# EAGLE board Backplane (EAGLE 7.2.0), part 1 of 2
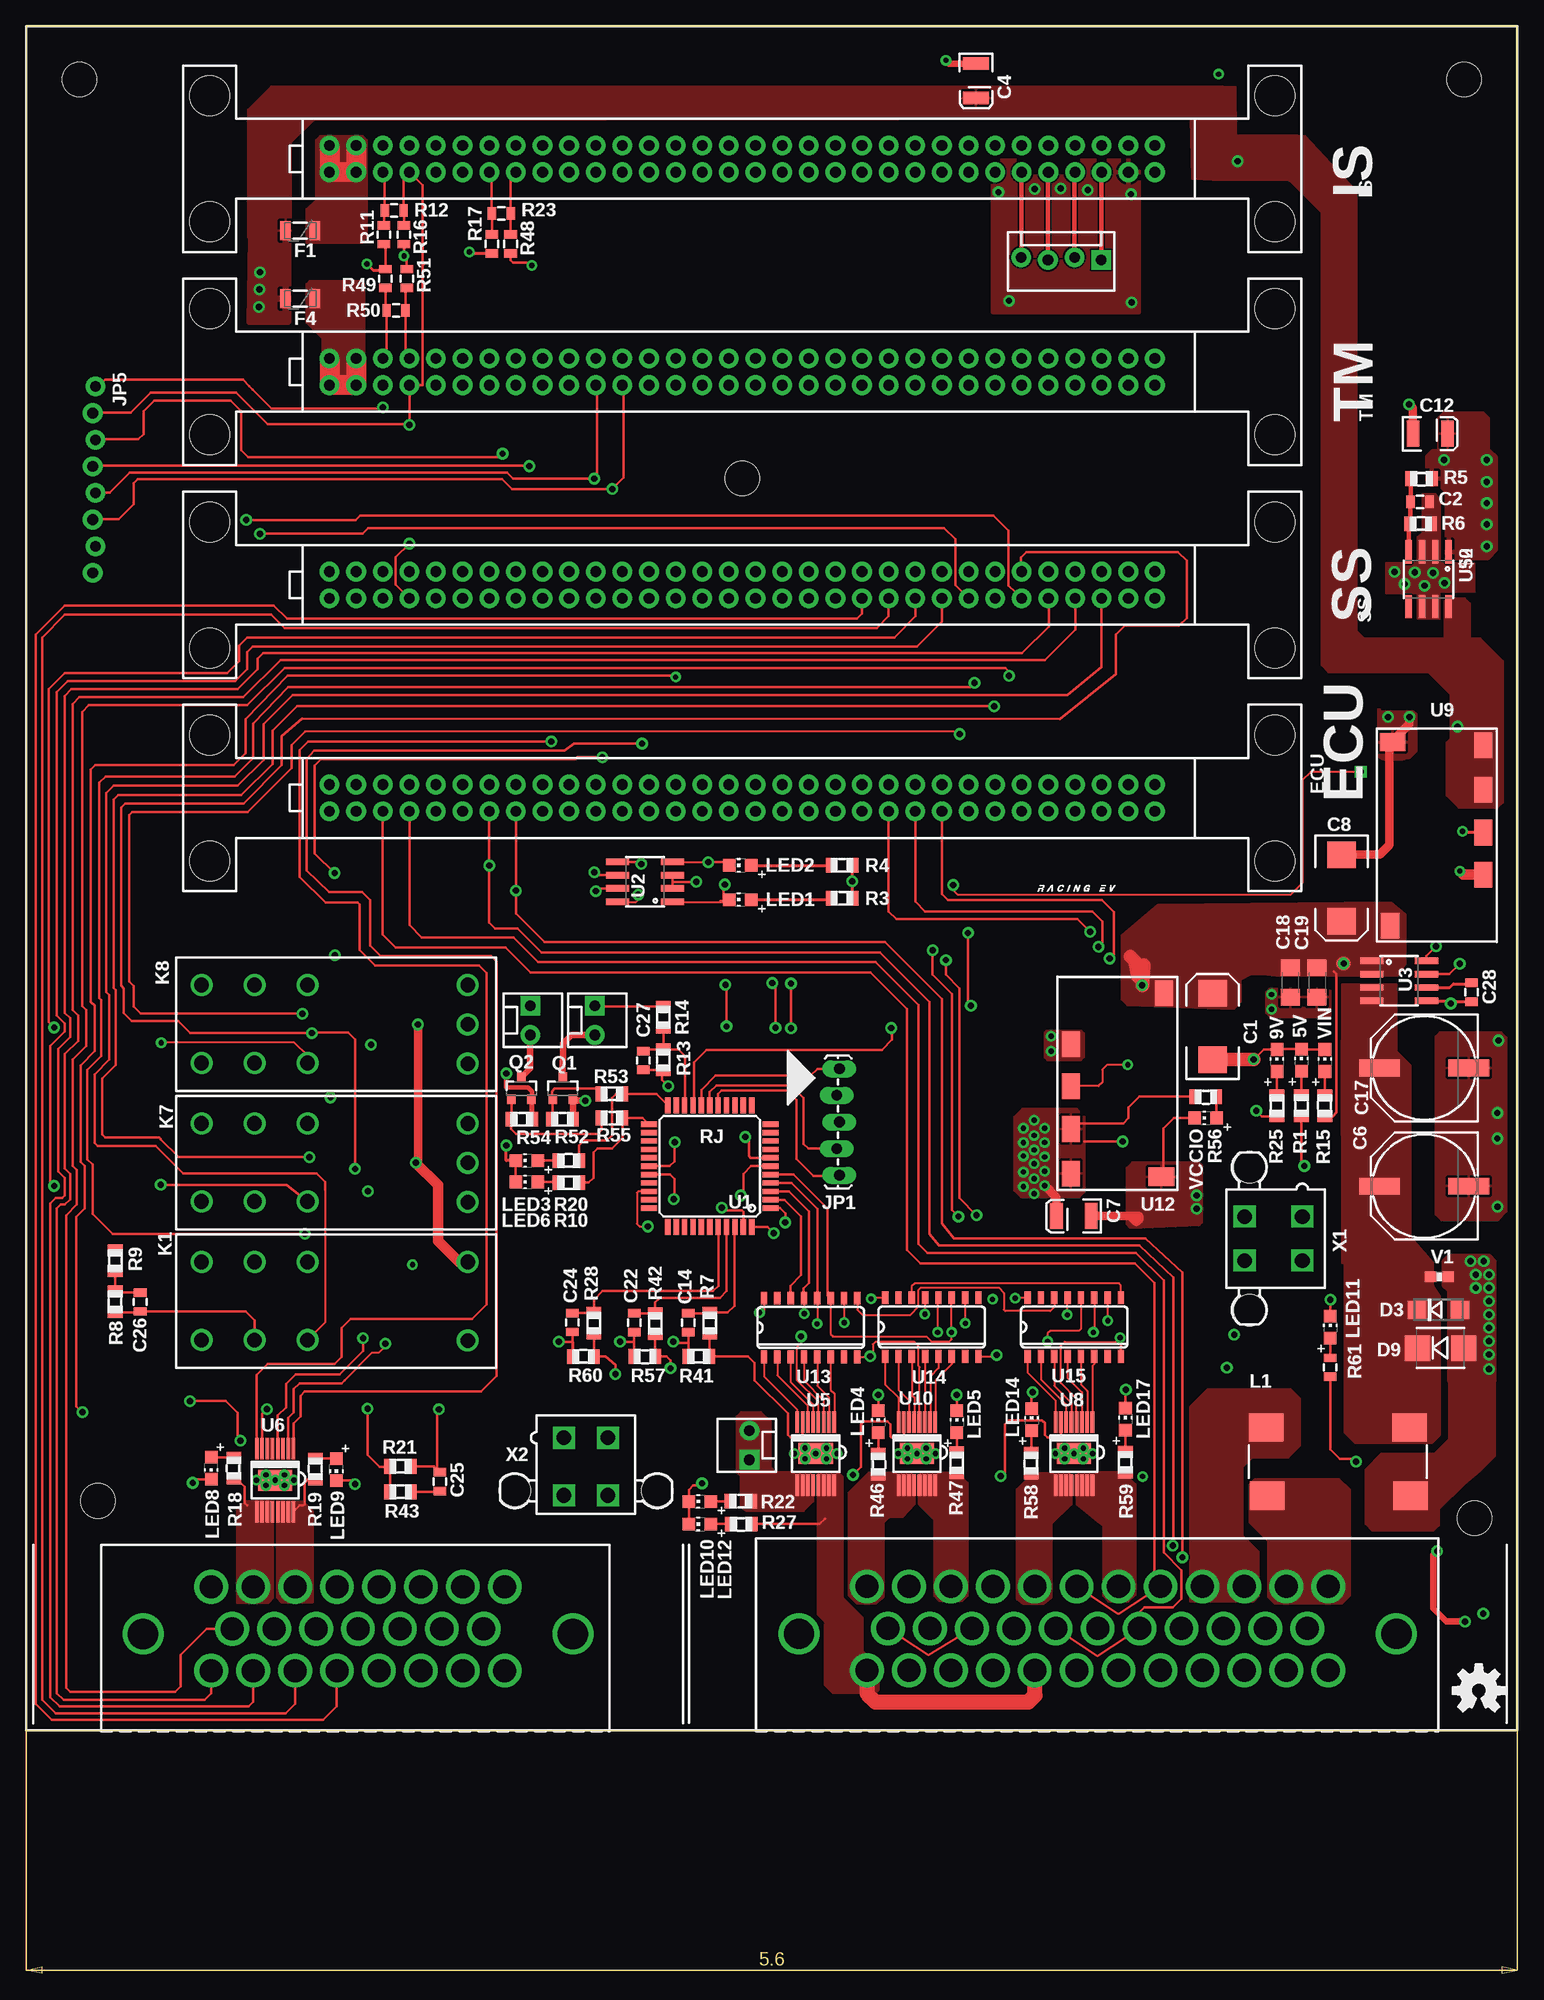
[diagram p5: board, top side]
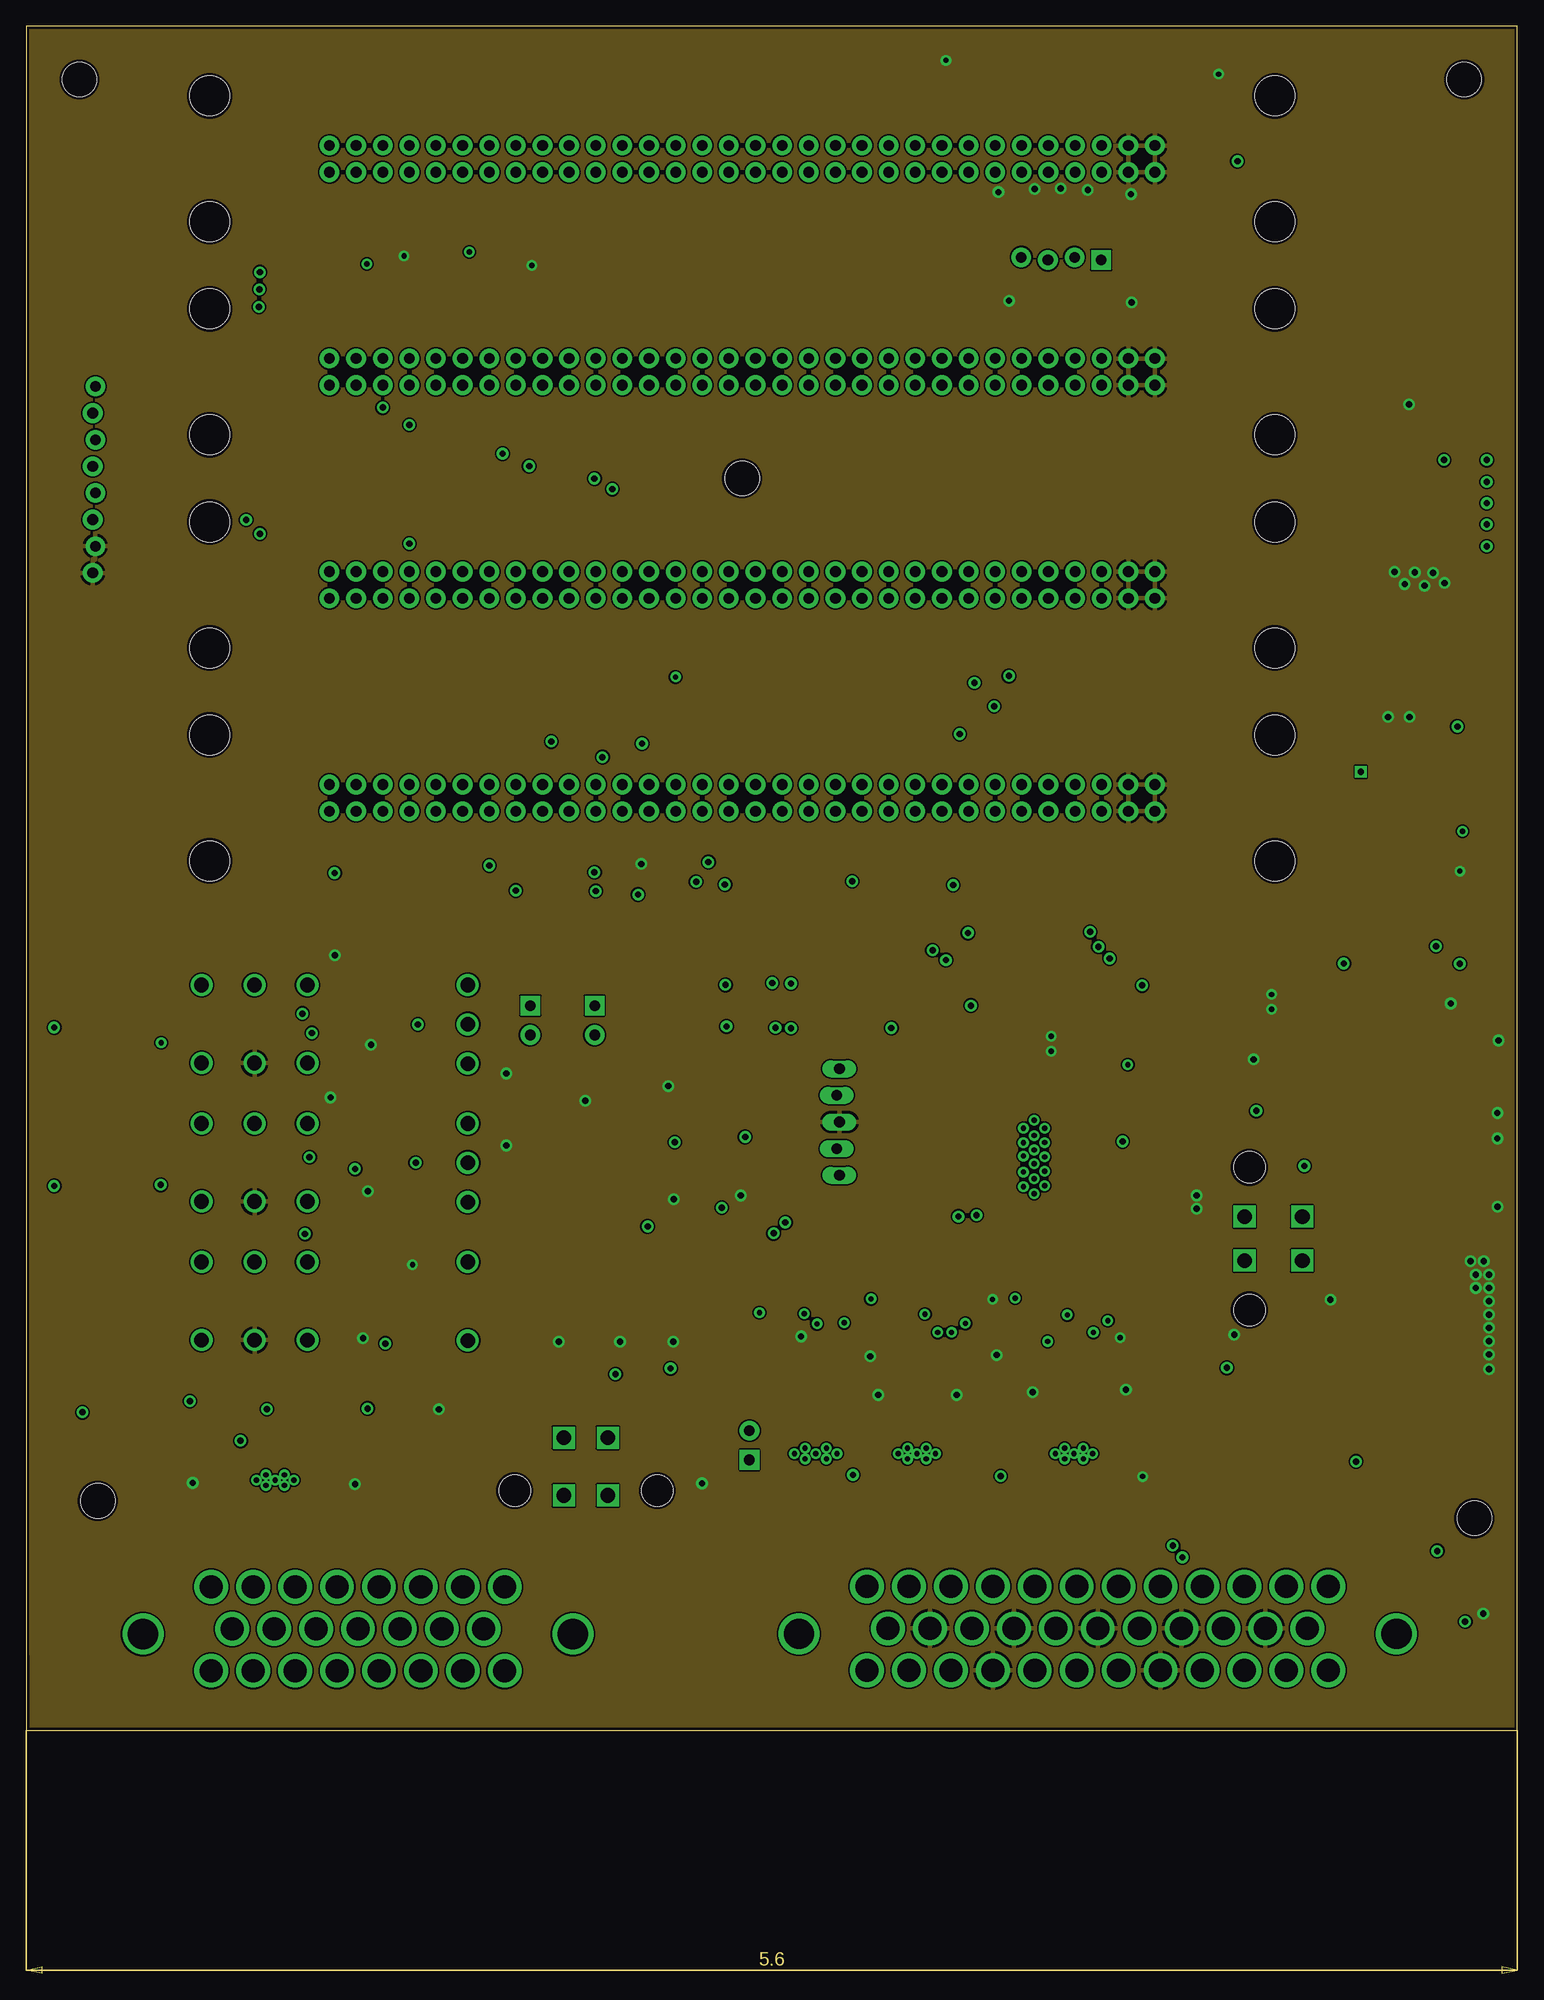
[diagram p6: board, inner layer Route2]
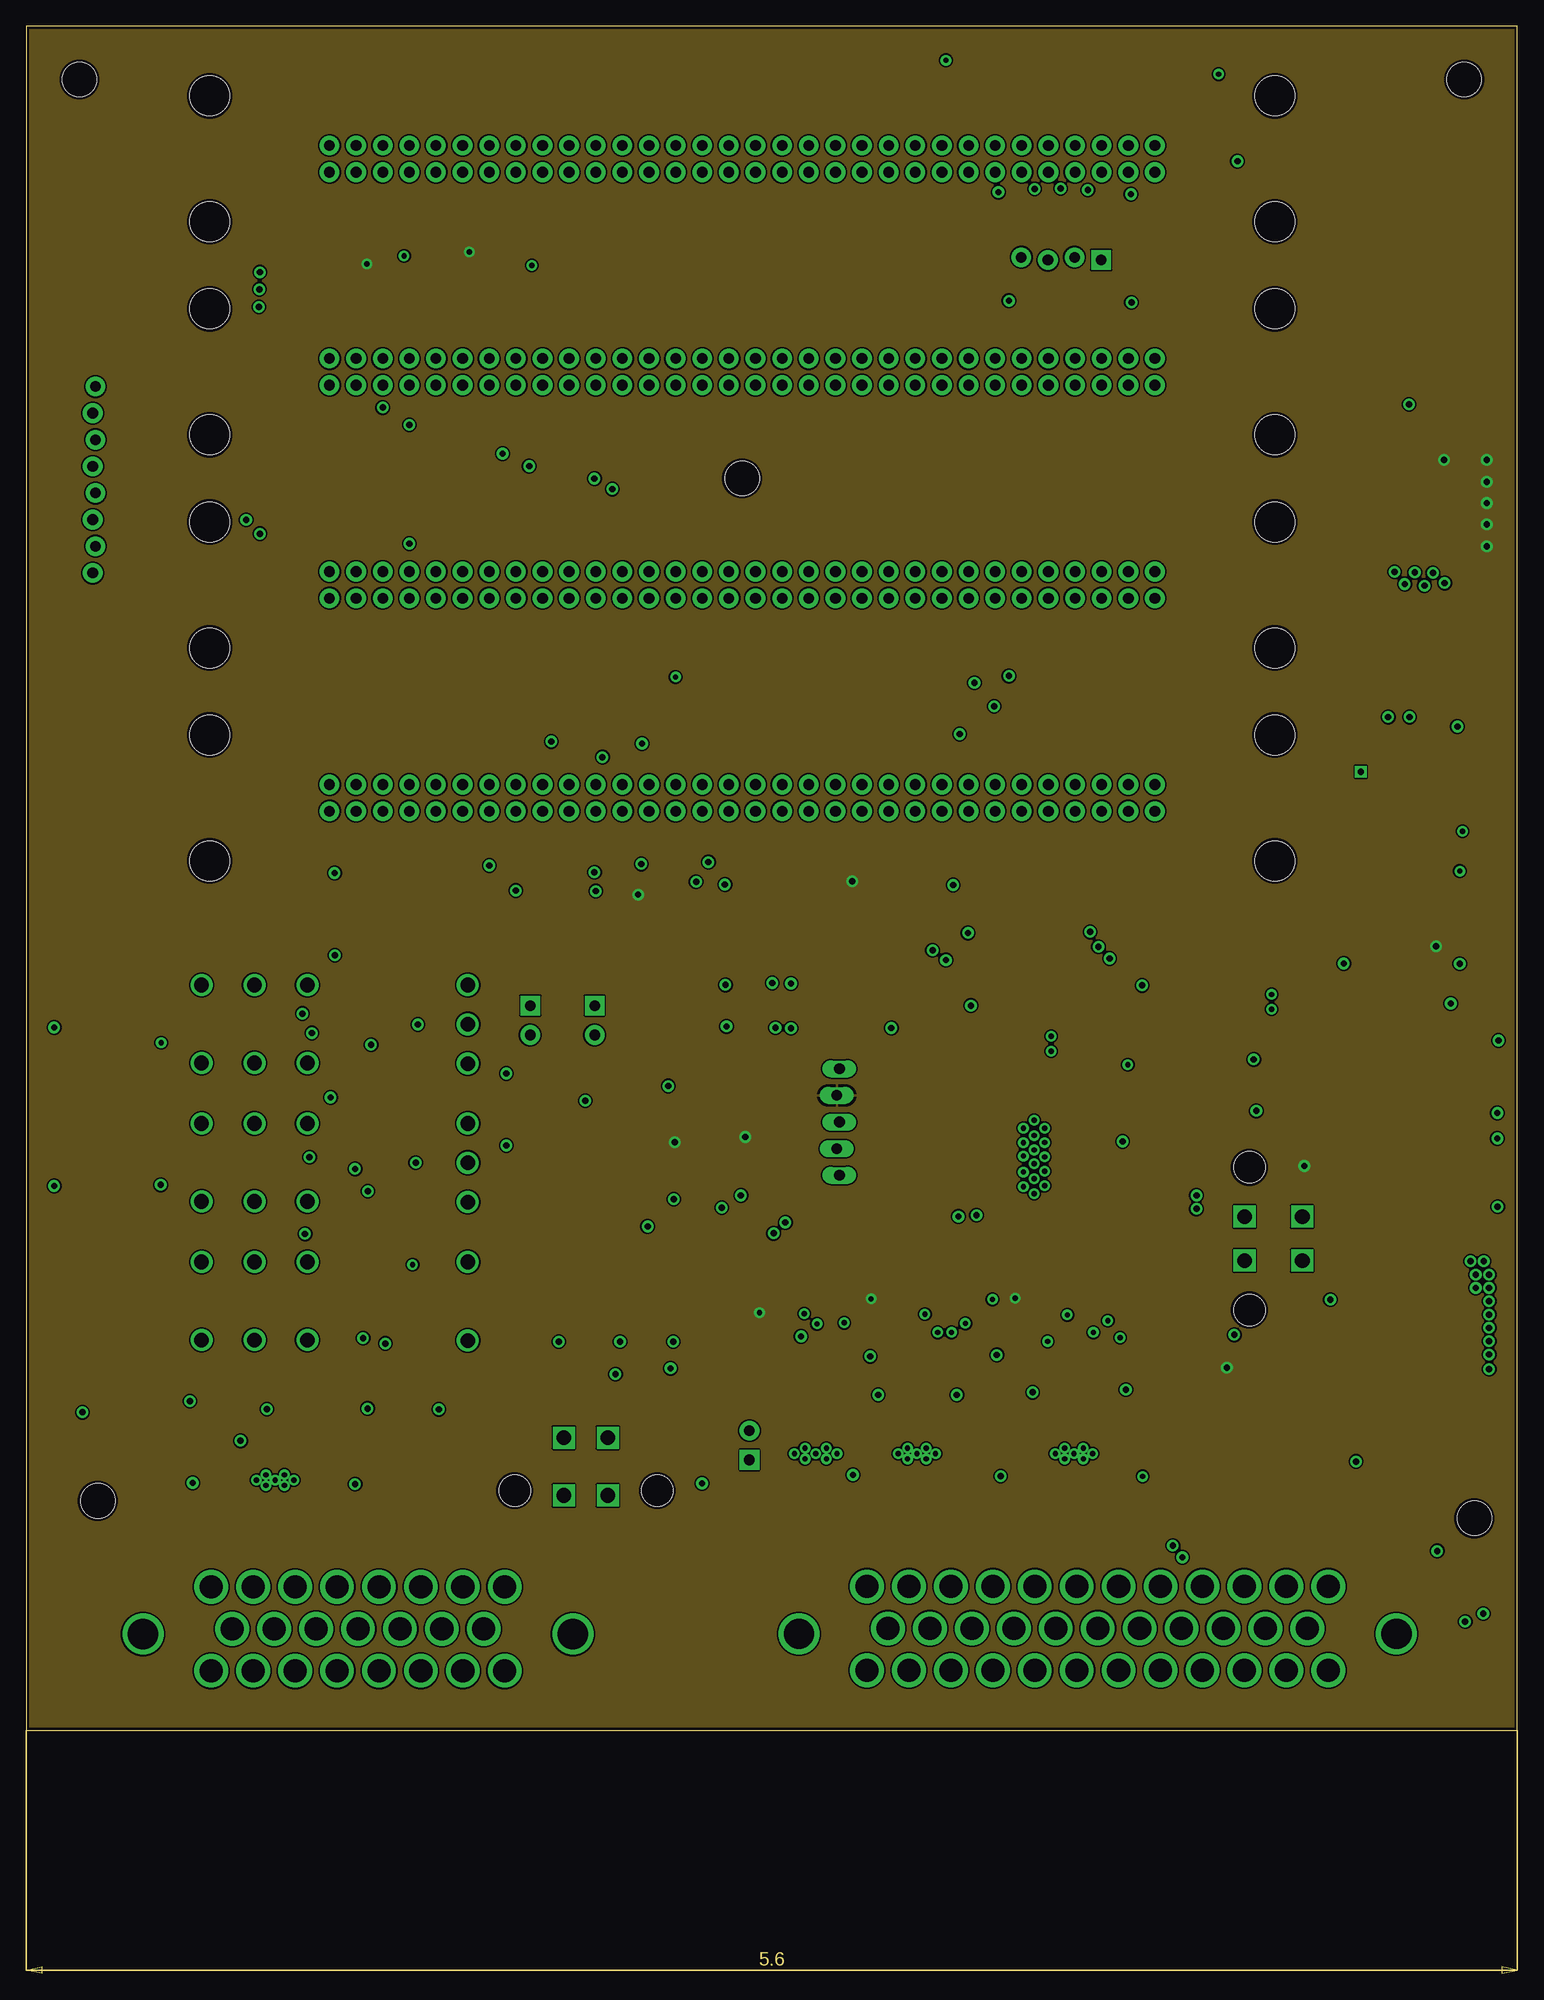
[diagram p7: board, inner layer Route15]
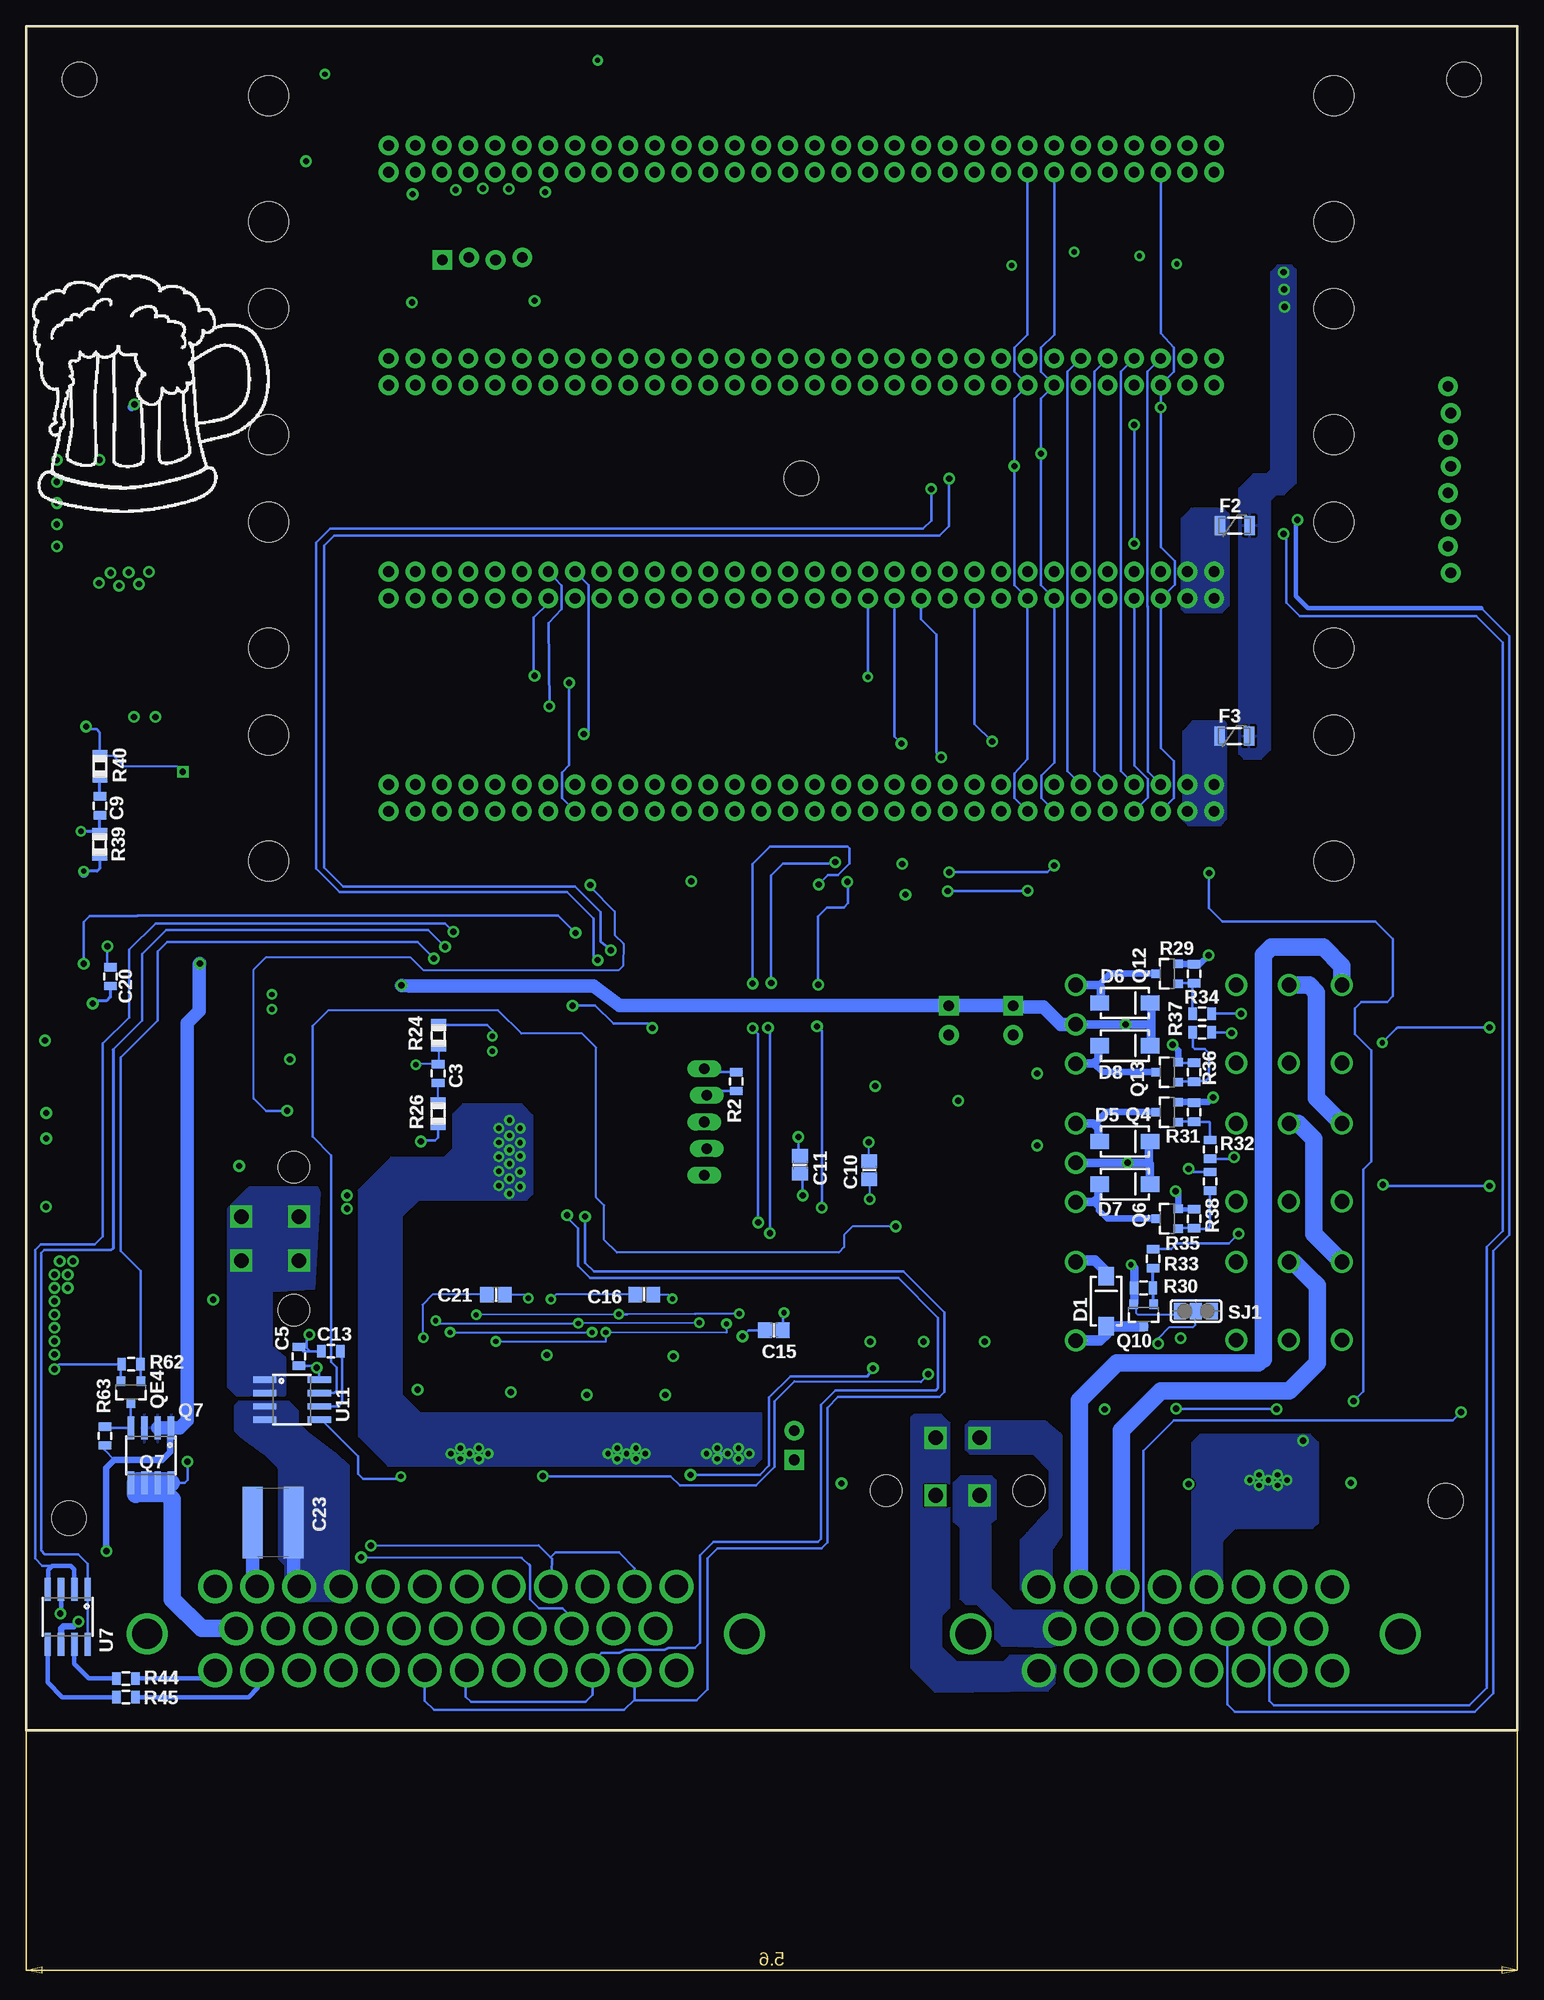
[diagram p8: board, bottom side, seen from below]

Size 142.24 x 162.56 mm. Coordinates in mm from the lower left corner, seen from the top.
Outline: 0,0 142.24,0 142.24,162.56 0,162.56 0,0
Copper layers (1*2*15*16): Top 0.035mm / dielectric 1.5mm / Route2 0.035mm / dielectric 0.15mm / Route15 0.035mm / dielectric 0.2mm / Bottom 0.035mm
Design rules "SparkFun4layer *": minimum track width 8mil, minimum drill 19mil, track to track 6mil, track to pad 6mil, pad to pad 6mil, via to via 6mil, smd to smd 6mil, copper to edge 10mil, drill to drill 6mil, minimum pad ring 12mil, minimum via ring 10mil, stop-mask expansion 4mil, vias tented up to drill 25mil, thermal gap 10mil
Net classes: 1 power: width 0.61 mm, drill 0.711 mm, clearance 0.203 mm
tRestrict: 1 lines

## Footprints (pad centres in the part's own frame; a part is rotated, then mirrored left to right if it is on the bottom)
CHIP-LED0805 = smd 1.2 x 1.2: A 0,-1.05; C 0,1.05
EIA7343 = smd 2.55 x 2.7: A 3.17,0; C -3.17,0
0805 = smd 0.8 x 1.2: 1 -0.9,0; 2 0.9,0
EIA3528 = smd 1.2 x 2.5: A 1.65,0; C -1.65,0
PANASONIC_G = smd 3.9 x 1.6: + 4.25,0; - -4.25,0
C0805 = smd 1.3 x 1.5: 1 -0.85,0; 2 0.85,0
1206 = smd 1.6 x 1.8: 1 -1.4,0; 2 1.4,0
C1825 = smd 1.9 x 6.8: 1 -1.95,0; 2 1.95,0
SMA-DIODE-KIT = smd 1.77 x 1.47: A -2.4,0; C 2.4,0
DO-214AC = smd 1.8 x 1.7: A 2.05,0; C -2.05,0
SMB-DIODE = smd 2.4 x 2.4: A 2.2,0; C -2.2,0
PTC-1206 = smd 1 x 1.8: 1 -1.4,0; 2 1.4,0
1-770669-1 = drill 2.2: 1 -14,4; 2 -10,4; 3 -6,4; 4 -2,4; 5 2,4; 6 6,4; 7 10,4; 8 14,4; 9 -12,0; 10 -8,0; 11 -4,0; 12 0,0; 13 4,0; 14 8,0; 15 12,0; 16 -14,-4; 17 -10,-4; 18 -6,-4; 19 -2,-4; 20 2,-4; 21 6,-4; 22 10,-4; 23 14,-4 | drill 2.9: 24 -20.5,-0.5; 25 20.5,-0.5
1-776163-2 = drill 2.2: 1 -22,4; 2 -18,4; 3 -14,4; 4 -10,4; 5 -6,4; 6 -2,4; 7 2,4; 8 6,4; 9 10,4; 10 14,4; 11 18,4; 12 22,4; 13 -20,0; 14 -16,0; 15 -12,0; 16 -8,0; 17 -4,0; 18 0,0; 19 4,0; 20 8,0; 21 12,0; 22 16,0; 23 20,0; 24 -22,-4; 25 -18,-4; 26 -14,-4; 27 -10,-4; 28 -6,-4; 29 -2,-4; 30 2,-4; 31 6,-4; 32 10,-4; 33 14,-4; 34 18,-4; 35 22,-4 | drill 2.88: TH1 -28.5,-0.5; TH2 28.5,-0.5
1X05_LOCK_LONGPADS = drill 1.016 long: 1 0,0; 2 2.54,-0.254; 3 5.08,0; 4 7.62,-0.254; 5 10.16,0
MOLEX-1X2_LOCK = drill 1.016 pad 1.88 square: 1 -0.127,0 | drill 1.016 pad 1.88: 2 2.667,0
1X08_LOCK_NO_SILK = drill 1.016 pad 1.88: 1 0,0.127; 2 2.54,-0.127; 3 5.08,0.127; 4 7.62,-0.127; 5 10.16,0.127; 6 12.7,-0.127; 7 15.24,0.127; 8 17.78,-0.127
MOLEX-1X4_LOCK = drill 1.016 pad 1.88 square: 1 0,0.127 | drill 1.016 pad 1.88: 2 2.54,-0.127; 3 5.08,0.127; 4 7.62,-0.127
RTE44024F = drill 1.4: 11 9.06,-3.75; 12 4.01,-3.75; 14 14.11,-3.75; 21 9.06,3.7; 22 4.01,3.7; 24 14.11,3.7; A1 -11.29,-3.75; A2 -11.29,3.75
RT424F24 = drill 1.4: 11 11.6,-3.75; 12 6.55,-3.75; 14 16.65,-3.75; 21 11.6,3.7; 22 6.55,3.7; 24 16.65,3.7; A1 -8.75,-3.75; A2 -8.75,3.75; A3 -8.75,0
ACM1513-551-2PL-TL = smd 3.3 x 2.7: IN+ -6.9,3.25; IN- -6.8,-3.25; OUT+ 6.8,3.25; OUT- 6.9,-3.25
SOT23-3 = smd 0.8 x 0.9: 1 -0.95,-1; 2 0.95,-1; 3 0,1.1
SO08 = smd 0.61 x 2.21: 1 -1.905,-2.616; 2 -0.635,-2.616; 3 0.635,-2.616; 4 1.905,-2.616; 5 1.905,2.616; 6 0.635,2.616; 7 -0.635,2.616; 8 -1.905,2.616
SOT-23 = smd 0.8 x 0.9: 1 -0.95,-0.23; 2 0.95,-0.23; 3 0,1.87
R0805 = smd 1.1 x 1.4: 1 -1,0; 2 1,0
PAD-JUMPER-3-NO_YES_SILK_FULL_BOX = smd 1.168 x 1.6: 1 -1.524,0; 2 0,0; 3 1.524,0
STAND-OFF = hole 3.302: 0,0
TQFP-44 = smd 1.5 x 0.5: 1 -5.8,4; 2 -5.8,3.2; 3 -5.8,2.4; 4 -5.8,1.6; 5 -5.8,0.8; 6 -5.8,0; 7 -5.8,-0.8; 8 -5.8,-1.6; 9 -5.8,-2.4; 10 -5.8,-3.2; 11 -5.8,-4; 23 5.8,-4; 24 5.8,-3.2; 25 5.8,-2.4; 26 5.8,-1.6; 27 5.8,-0.8; 28 5.8,0; 29 5.8,0.8; 30 5.8,1.6; 31 5.8,2.4; 32 5.8,3.2; 33 5.8,4 | smd 0.5 x 1.5: 12 -4,-5.8; 13 -3.2,-5.8; 14 -2.4,-5.8; 15 -1.6,-5.8; 16 -0.8,-5.8; 17 0,-5.8; 18 0.8,-5.8; 19 1.6,-5.8; 20 2.4,-5.8; 21 3.2,-5.8; 22 4,-5.8; 34 4,5.8; 35 3.2,5.8; 36 2.4,5.8; 37 1.6,5.8; 38 0.8,5.8; 39 0,5.8; 40 -0.8,5.8; 41 -1.6,5.8; 42 -2.4,5.8; 43 -3.2,5.8; 44 -4,5.8
SO-8 = smd 0.61 x 2.21: 1 -1.905,-2.616; 2 -0.635,-2.616; 3 0.635,-2.616; 4 1.905,-2.616; 5 1.905,2.616; 6 0.635,2.616; 7 -0.635,2.616; 8 -1.905,2.616
SSO-16-POWER = smd 2.032 x 0.35: 1 -3,1.75; 2 -3,1.25; 3 -3,0.75; 4 -3,0.25; 5 -3,-0.25; 6 -3,-0.75; 7 -3,-1.25; 8 -3,-1.75; 9 3,-1.75; 10 3,-1.25; 11 3,-0.75; 12 3,-0.25; 13 3,0.25; 14 3,0.75; 15 3,1.25; 16 3,1.75 | smd 2 x 3.25: EP 0,0
APXW005A0X43-SRZ = smd 1.73 x 2.44: 1 1.28,1.52 | smd 2.44 x 1.73: 2 18.796,1.27; 3 13.92,10.16; 4 9.906,10.16; 5 5.842,10.16; 6 1.574,10.16
SO16 = smd 0.6 x 1.2: 1 -4.445,-2.8; 2 -3.175,-2.8; 3 -1.905,-2.8; 4 -0.635,-2.8; 5 0.635,-2.8; 6 1.905,-2.8; 7 3.175,-2.8; 8 4.445,-2.8; 9 4.445,2.8; 10 3.175,2.8; 11 1.905,2.8; 12 0.635,2.8; 13 -0.635,2.8; 14 -1.905,2.8; 15 -3.175,2.8; 16 -4.445,2.8
CS64 = drill 1.016 pad 1.88: 1 -39.37,-1.27; 2 -36.83,-1.27; 3 -34.29,-1.27; 4 -31.75,-1.27; 5 -29.21,-1.27; 6 -26.67,-1.27; 7 -24.13,-1.27; 8 -21.59,-1.27; 9 -19.05,-1.27; 10 -16.51,-1.27; 11 -13.97,-1.27; 12 -11.43,-1.27; 13 -8.89,-1.27; 14 -6.35,-1.27; 15 -3.81,-1.27; 16 -1.27,-1.27; 17 1.27,-1.27; 18 3.81,-1.27; 19 6.35,-1.27; 20 8.89,-1.27; 21 11.43,-1.27; 22 13.97,-1.27; 23 16.51,-1.27; 24 19.05,-1.27; 25 21.59,-1.27; 26 24.13,-1.27; 27 26.67,-1.27; 28 29.21,-1.27; 29 31.75,-1.27; 30 34.29,-1.27; 31 36.83,-1.27; 32 39.37,-1.27; 33 -39.37,1.27; 34 -36.83,1.27; 35 -34.29,1.27; 36 -31.75,1.27; 37 -29.21,1.27; 38 -26.67,1.27; 39 -24.13,1.27; 40 -21.59,1.27; 41 -19.05,1.27; 42 -16.51,1.27; 43 -13.97,1.27; 44 -11.43,1.27; 45 -8.89,1.27; 46 -6.35,1.27; 47 -3.81,1.27; 48 -1.27,1.27; 49 1.27,1.27; 50 3.81,1.27; 51 6.35,1.27; 52 8.89,1.27; 53 11.43,1.27; 54 13.97,1.27; 55 16.51,1.27; 56 19.05,1.27; 57 21.59,1.27; 58 24.13,1.27; 59 26.67,1.27; 60 29.21,1.27; 61 31.75,1.27; 62 34.29,1.27; 63 36.83,1.27; 64 39.37,1.27 | hole 3.81: -50.8,-6.007; -50.8,6.007; 50.8,6.007; 50.8,-6.007
0603-RES = smd 1.1 x 1: 1 -0.85,0; 2 0.85,0
5566-4 = drill 1.4 square: 1 2.1,-2.75; 2 -2.1,-2.75; 3 2.1,2.75; 4 -2.1,2.75 | hole 3: 6.8,2.29; -6.8,2.29

## Placement (x,y rotation side)
5V  Green  [CHIP-LED0805]  121.64,63.93 0 top
9V  Green  [CHIP-LED0805]  119.3,63.91 0 top
C1  10uF  [EIA7343]  113.18,67.16 90 top
C2  0.1uF  [0805]  132.97,117.2 0 top
C3  DNP  [0805]  102.95,62.66 90 bottom
C4  10uF  [EIA3528]  90.6,157.35 270 top
C5  0.1uF  [0805]  116.23,35.69 90 bottom
C6  100uF  [PANASONIC_G]  133.35,51.92 180 top
C7  10uF  [EIA3528]  99.92,49.07 180 top
C8  10uF  [EIA7343]  125.48,80.37 270 top
C9  dnp  [0805]  135.2,88.19 270 bottom
C10  .1uF  [C0805]  61.82,53.44 270 bottom
C11  .1uF  [C0805]  68.43,53.95 270 bottom
C12  10uF  [EIA3528]  133.93,123.7 0 top
C13  0.1uF  [0805]  113.18,36.17 180 bottom
C14  10nF  [0805]  63.14,38.89 270 top
C15  .1uF  [C0805]  70.92,38.18 180 bottom
C16  .1uF  [C0805]  83.29,41.58 180 bottom
C17  100uF  [PANASONIC_G]  133.35,63.2 180 top
C18  1uf  [1206]  120.57,71.35 270 top
C19  1uf  [1206]  123.11,71.35 270 top
C20  0.1uF  [0805]  134.21,71.91 270 bottom
C21  .1uF  [C0805]  97.43,41.58 180 bottom
C22  10nF  [0805]  57.99,38.89 270 top
C23  1000pf  [C1825]  118.69,19.84 180 bottom
C24  10nF  [0805]  52.1,38.91 270 top
C25  10nF  [0805]  39.45,23.75 90 top
C26  1uF  [0805]  10.87,40.87 270 top
C27  1uF  [0805]  58.85,63.91 270 top
C28  .1uF  [0805]  137.87,70.41 270 top
D1  ES1AE-TP  [SMA-DIODE-KIT]  39.22,40.94 90 bottom
D3  TVS  [DO-214AC]  134.72,40.11 0 top
D5  ES1AE-TP  [SMA-DIODE-KIT]  37.44,56.18 0 bottom
D6  ES1AE-TP  [SMA-DIODE-KIT]  37.44,69.39 0 bottom
D7  ES1AE-TP  [SMA-DIODE-KIT]  37.44,52.12 0 bottom
D8  ES1AE-TP  [SMA-DIODE-KIT]  37.44,65.33 0 bottom
D9  30V  [SMB-DIODE]  134.92,36.47 0 top
F1  PTCSMD  [PTC-1206]  26.14,143.05 180 top
F2  PTCSMD  [PTC-1206]  26.95,114.91 0 bottom
F3  PTCSMD  [PTC-1206]  27,94.84 0 bottom
F4  PTCSMD  [PTC-1206]  26.14,136.58 180 top
J1  M23  [1-770669-1]  31.65,9.7 0 top
J2  M35  [1-776163-2]  102.21,9.73 0 top
JP1  [1X05_LOCK_LONGPADS]  77.57,63.12 270 top
JP2  M02POLAR_LOCK  [MOLEX-1X2_LOCK]  68.99,25.93 90 top
JP3  M02POLAR_LOCK  [MOLEX-1X2_LOCK]  54.23,69.01 270 top
JP4  M02POLAR_LOCK  [MOLEX-1X2_LOCK]  48.08,69.01 270 top
JP5  [1X08_LOCK_NO_SILK]  6.48,128.19 270 top
JP7  Headphone  [MOLEX-1X4_LOCK]  102.54,140.39 180 top
K1  RTE44024F  [RTE44024F]  30.84,40.94 180 top
K7  RT424F24  [RT424F24]  33.38,54.15 180 top
K8  RT424F24  [RT424F24]  33.38,67.36 180 top
L1  ACM1513-551-2PL-TL  [ACM1513-551-2PL-TL]  125.17,25.65 0 top
LED1  green  [CHIP-LED0805]  68.12,79.25 90 top
LED2  red  [CHIP-LED0805]  68.12,82.52 90 top
LED3  red  [CHIP-LED0805]  47.75,54.36 90 top
LED4  green  [CHIP-LED0805]  81.28,29.46 0 top
LED5  green  [CHIP-LED0805]  88.77,29.46 0 top
LED6  green  [CHIP-LED0805]  47.75,52.32 90 top
LED8  green  [CHIP-LED0805]  17.65,25.02 180 top
LED9  green  [CHIP-LED0805]  29.59,24.89 180 top
LED10  green  [CHIP-LED0805]  64.26,21.84 90 top
LED11  [CHIP-LED0805]  124.38,38.48 0 top
LED12  green  [CHIP-LED0805]  64.26,19.68 90 top
LED14  green  [CHIP-LED0805]  95.91,29.67 0 top
LED17  green  [CHIP-LED0805]  104.85,29.69 0 top
Q1  BSS123  [SOT23-3]  51.18,61.21 0 top
Q2  BSS123  [SOT23-3]  47.24,61.21 0 top
Q4  BSS123  [SOT23-3]  33.38,58.98 90 bottom
Q6  BSS123  [SOT23-3]  33.38,48.82 90 bottom
Q7  Si9435BDY  [SO08]  130.33,26.24 180 bottom
Q10  BSS123  [SOT23-3]  35.66,39.67 180 bottom
Q12  BSS123  [SOT23-3]  33.38,72.19 90 bottom
Q13  BSS123  [SOT23-3]  33.38,62.79 90 bottom
QE4  BSS123  [SOT-23]  132.26,33.07 180 bottom
R1  1k  [R0805]  121.64,59.61 270 top
R2  10k  [0805]  74.5,61.9 270 bottom
R3  1k  [R0805]  77.83,79.38 0 top
R4  1k  [R0805]  77.83,82.52 0 top
R5  1k  [R0805]  133.1,119.41 0 top
R6  1k  [R0805]  133.02,115.09 180 top
R7  1k  [R0805]  65.2,38.86 270 top
R8  24k  [R0805]  8.48,40.89 90 top
R9  91k  [R0805]  8.48,44.81 90 top
R10  1k  [R0805]  51.77,52.26 0 top
R11  523  [0805]  34.14,142.67 270 top
R12  120  [0805]  35.1,144.98 180 top
R13  24k  [R0805]  60.78,63.96 90 top
R14  91k  [R0805]  60.78,68.05 90 top
R15  1.21k  [R0805]  123.88,59.59 270 top
R16  523  [0805]  36.04,142.67 90 top
R17  523  [0805]  44.42,141.78 270 top
R18  1k  [R0805]  19.81,25.02 270 top
R19  1k  [R0805]  27.58,24.94 270 top
R20  1k  [R0805]  51.75,54.34 0 top
R21  1k  [R0805]  35.71,25.2 0 top
R22  1k  [R0805]  68.17,21.87 0 top
R23  120  [0805]  45.31,144.7 180 top
R24  8.43k  [R0805]  102.9,66.29 90 bottom
R25  1.21k  [R0805]  119.3,59.59 270 top
R26  dnp  [R0805]  102.95,58.85 90 bottom
R27  1k  [R0805]  68.2,19.68 0 top
R28  1k  [R0805]  54.15,38.86 270 top
R29  10k  [0805]  30.84,72.19 270 bottom
R30  10k  [0805]  35.66,42.21 0 bottom
R31  10k  [0805]  30.84,58.98 270 bottom
R32  1k  [0805]  29.31,55.42 270 bottom
R33  1k  [0805]  34.75,45.01 90 bottom
R34  1k  [0805]  30.07,68.38 0 bottom
R35  10k  [0805]  30.84,48.82 270 bottom
R36  10k  [0805]  30.84,62.79 270 bottom
R37  1k  [0805]  30.07,66.6 180 bottom
R38  1k  [0805]  29.31,52.37 270 bottom
R39  8.43k  [R0805]  135.23,84.51 270 bottom
R40  dnp  [R0805]  135.2,91.97 270 bottom
R41  1k  [R0805]  64.16,35.69 180 top
R42  1k  [R0805]  59.99,38.81 270 top
R43  1k  [R0805]  35.71,22.76 180 top
R44  0  [0805]  132.72,4.95 0 bottom
R45  0  [0805]  132.72,3.17 0 bottom
R46  1k  [R0805]  81.28,25.4 270 top
R47  1k  [R0805]  88.77,25.53 270 top
R48  523  [0805]  46.2,141.78 90 top
R49  523  [0805]  34.26,138.48 90 top
R50  120  [0805]  35.28,135.43 180 top
R51  523  [0805]  36.3,138.48 270 top
R52  100k  [R0805]  51.16,58.29 180 top
R53  1k  [R0805]  55.88,60.71 0 top
R54  100k  [R0805]  47.27,58.29 180 top
R55  1k  [R0805]  55.88,58.42 0 top
R56  1.21k  [R0805]  112.52,60.45 180 top
R57  1k  [R0805]  59.03,35.69 180 top
R58  1k  [R0805]  95.86,25.5 270 top
R59  1k  [R0805]  104.85,25.58 270 top
R60  1k  [R0805]  53.16,35.66 180 top
R61  2.2k  [0805]  124.38,34.63 270 top
R62  10k  [0805]  132.23,34.92 0 bottom
R63  22k  [0805]  134.75,28.09 270 bottom
SJ1  [PAD-JUMPER-3-NO_YES_SILK_FULL_BOX]  30.66,40.01 180 bottom
STANDOFF1  STAND-OFF  [STAND-OFF]  137.16,157.48 0 top
STANDOFF2  STAND-OFF  [STAND-OFF]  68.3,119.43 90 top
STANDOFF3  STAND-OFF  [STAND-OFF]  138.15,20.24 0 top
STANDOFF4  STAND-OFF  [STAND-OFF]  5.08,157.48 0 top
STANDOFF5  STAND-OFF  [STAND-OFF]  6.83,21.89 0 top
U1  PIC18F45K22  [TQFP-44]  65.2,53.82 180 top
U2  SN75HVD08DR  [SO-8]  59.03,80.95 90 top
U3  ACS712  [SO-8]  130.96,71.5 270 top
U5  VND7040AJTR-E  [SSO-16-POWER]  75.31,26.42 270 top
U6  VND7040AJTR-E  [SSO-16-POWER]  23.75,23.88 270 top
U7  FAN3278TMX  [SO-8]  138.28,10.85 180 bottom
U8  VND7040AJTR-E  [SSO-16-POWER]  99.95,26.42 270 top
U9  APXW005A0X43-SRZ  [APXW005A0X43-SRZ]  128.83,95.55 270 top
U10  VND7040AJTR-E  [SSO-16-POWER]  84.96,26.42 270 top
U11  ACS712  [SO-8]  116.89,31.55 270 bottom
U12  APXW005A0X43-SRZ  [APXW005A0X43-SRZ]  109.8,51.54 90 top
U13  74LS595D  [SO16]  74.83,38.43 0 top
U14  74LS595D  [SO16]  86.39,38.48 0 top
U15  74LS595D  [SO16]  99.97,38.48 0 top
U$1  CARD-SLOT  [CS64]  68.3,88.95 0 top
U$2  LM2931  [SO08]  133.78,109.8 180 top
U$3  BEERL  [B-L]  141.63,116.18 0 bottom
U$4  CARD-SLOT  [CS64]  68.3,129.59 0 top
U$5  CARD-SLOT  [CS64]  68.3,149.91 0 top
U$6  CARD-SLOT  [CS64]  68.3,109.27 0 top
U$7  LOGO  [L-MS]  93.47,79.22 0 top
U$8  OSHW-LOGOM  [OSHW-LOGO-M]  138.56,3.81 0 top
U$9  INDPK1  [PICKIT-PIN-1]  75.21,62.26 90 top
V1  30V  [0603-RES]  134.8,43.28 180 top
VCCIO  Green  [CHIP-LED0805]  112.52,58.42 90 top
VIN  Green  [CHIP-LED0805]  123.88,63.91 0 top
X1  5566-4  [5566-4]  118.97,46.91 90 top
X2  5566-4  [5566-4]  53.39,25.17 180 top